# Altium schematic sheet ZYNQ_US_SOC_PL_GTX.SchDoc (part 3 of 3)
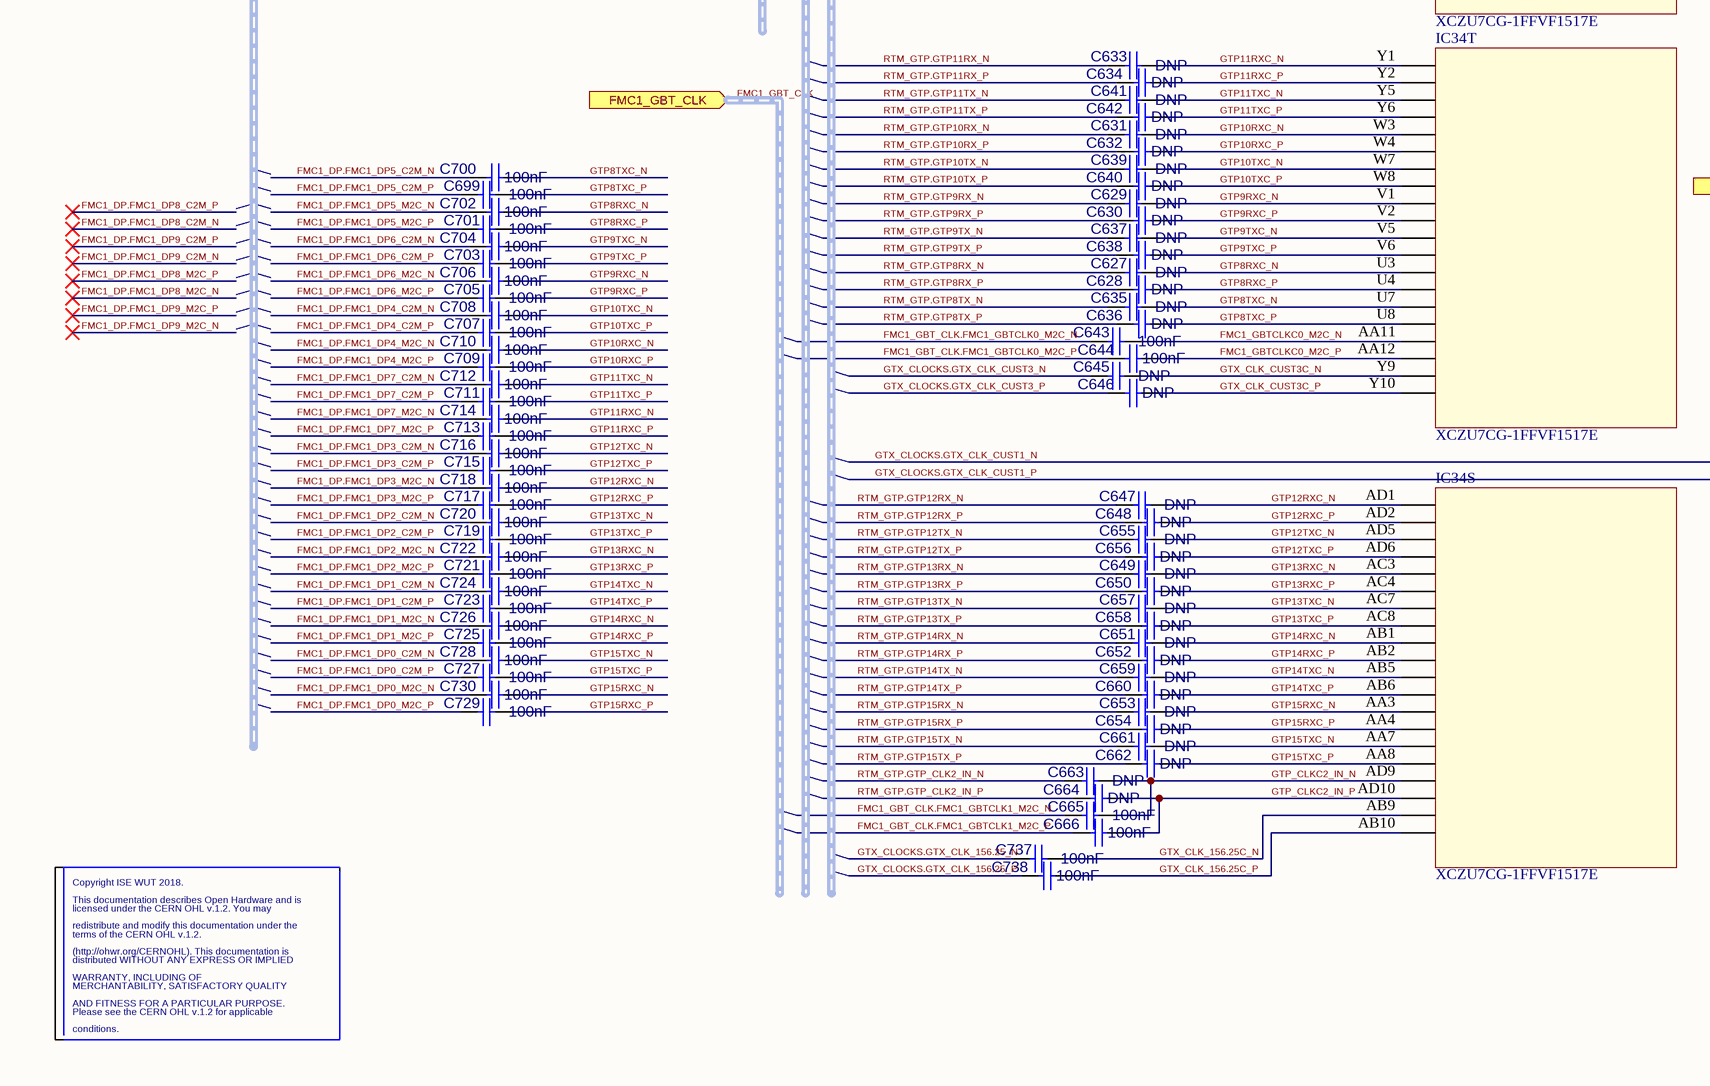
[diagram p4: ZYNQ_US_SOC_PL_GTX.SchDoc, bottom left]

## Library data of the parts (continued)
C735 = CAPC0603X33N: Capacitor - non polarized CAPC0603X33N 100nF; Manufacturer Part Number: CC0201_100NF_6.3V_10%_X5R; Manufacturer: GENERIC; Part Description: SMD Multilayer Chip Ceramic Capacitor; CmpIndex: 946; DXDB_LIBNAME: Capacitors SMD; Ref Designator: C735; SymIndex: 331; Tolerance: ±10%; Cell Name: CAPC0603X33N; Part Name: Capacitor - non polarized CAPC0603X33N; Part Number: Capacitor - non polarized CAPC0603X33N; Orientation: 0 = 0
C736 = CAPC0603X33N: Capacitor - non polarized CAPC0603X33N 100nF; Manufacturer Part Number: CC0201_100NF_6.3V_10%_X5R; Manufacturer: GENERIC; Part Description: SMD Multilayer Chip Ceramic Capacitor; CmpIndex: 945; DXDB_LIBNAME: Capacitors SMD; Ref Designator: C736; SymIndex: 331; Tolerance: ±10%; Cell Name: CAPC0603X33N; Part Name: Capacitor - non polarized CAPC0603X33N; Part Number: Capacitor - non polarized CAPC0603X33N; Orientation: 0 = 0
C737 = CAPC0603X33N: Capacitor - non polarized CAPC0603X33N 100nF; Manufacturer Part Number: CC0201_100NF_6.3V_10%_X5R; Manufacturer: GENERIC; Part Description: SMD Multilayer Chip Ceramic Capacitor; CmpIndex: 948; DXDB_LIBNAME: Capacitors SMD; Ref Designator: C737; SymIndex: 331; Tolerance: ±10%; Cell Name: CAPC0603X33N; Part Name: Capacitor - non polarized CAPC0603X33N; Part Number: Capacitor - non polarized CAPC0603X33N; Orientation: 0 = 0
C738 = CAPC0603X33N: Capacitor - non polarized CAPC0603X33N 100nF; Manufacturer Part Number: CC0201_100NF_6.3V_10%_X5R; Manufacturer: GENERIC; Part Description: SMD Multilayer Chip Ceramic Capacitor; CmpIndex: 947; DXDB_LIBNAME: Capacitors SMD; Ref Designator: C738; SymIndex: 331; Tolerance: ±10%; Cell Name: CAPC0603X33N; Part Name: Capacitor - non polarized CAPC0603X33N; Part Number: Capacitor - non polarized CAPC0603X33N; Orientation: 0 = 0
C739 = CAPC0603X33N: Capacitor - non polarized CAPC0603X33N 100nF; Manufacturer Part Number: CC0201_100NF_6.3V_10%_X5R; Manufacturer: GENERIC; Part Description: SMD Multilayer Chip Ceramic Capacitor; CmpIndex: 949; DXDB_LIBNAME: Capacitors SMD; Ref Designator: C739; SymIndex: 331; Tolerance: ±10%; Cell Name: CAPC0603X33N; Part Name: Capacitor - non polarized CAPC0603X33N; Part Number: Capacitor - non polarized CAPC0603X33N; Orientation: 0 = 0
C740 = CAPC0603X33N: Capacitor - non polarized CAPC0603X33N 100nF; Manufacturer Part Number: CC0201_100NF_6.3V_10%_X5R; Manufacturer: GENERIC; Part Description: SMD Multilayer Chip Ceramic Capacitor; CmpIndex: 950; DXDB_LIBNAME: Capacitors SMD; Ref Designator: C740; SymIndex: 331; Tolerance: ±10%; Cell Name: CAPC0603X33N; Part Name: Capacitor - non polarized CAPC0603X33N; Part Number: Capacitor - non polarized CAPC0603X33N; Orientation: 0 = 0
C741 = CAPC0603X33N: Capacitor - non polarized CAPC0603X33N 100nF; Manufacturer Part Number: CC0201_100NF_6.3V_10%_X5R; Manufacturer: GENERIC; Part Description: SMD Multilayer Chip Ceramic Capacitor; CmpIndex: 951; DXDB_LIBNAME: Capacitors SMD; Ref Designator: C741; SymIndex: 331; Tolerance: ±10%; Cell Name: CAPC0603X33N; Part Name: Capacitor - non polarized CAPC0603X33N; Part Number: Capacitor - non polarized CAPC0603X33N; Orientation: 0 = 0
C742 = CAPC0603X33N: Capacitor - non polarized CAPC0603X33N 100nF; Manufacturer Part Number: CC0201_100NF_6.3V_10%_X5R; Manufacturer: GENERIC; Part Description: SMD Multilayer Chip Ceramic Capacitor; CmpIndex: 952; DXDB_LIBNAME: Capacitors SMD; Ref Designator: C742; SymIndex: 331; Tolerance: ±10%; Cell Name: CAPC0603X33N; Part Name: Capacitor - non polarized CAPC0603X33N; Part Number: Capacitor - non polarized CAPC0603X33N; Orientation: 0 = 0
C925 = CAPC0603X33N: Capacitor - non polarized CAPC0603X33N 100nF; Manufacturer Part Number: CC0201_100NF_6.3V_10%_X5R; Manufacturer: GENERIC; Part Description: SMD Multilayer Chip Ceramic Capacitor; CmpIndex: 1180; DXDB_LIBNAME: Capacitors SMD; Ref Designator: C925; SymIndex: 331; Tolerance: ±10%; Cell Name: CAPC0603X33N; Part Name: Capacitor - non polarized CAPC0603X33N; Part Number: Capacitor - non polarized CAPC0603X33N; Orientation: 0 = 0
C926 = CAPC0603X33N: Capacitor - non polarized CAPC0603X33N 100nF; Manufacturer Part Number: CC0201_100NF_6.3V_10%_X5R; Manufacturer: GENERIC; Part Description: SMD Multilayer Chip Ceramic Capacitor; CmpIndex: 1178; DXDB_LIBNAME: Capacitors SMD; Ref Designator: C926; SymIndex: 331; Tolerance: ±10%; Cell Name: CAPC0603X33N; Part Name: Capacitor - non polarized CAPC0603X33N; Part Number: Capacitor - non polarized CAPC0603X33N; Orientation: 0 = 0
C927 = CAPC0603X33N: Capacitor - non polarized CAPC0603X33N 100nF; Manufacturer Part Number: CC0201_100NF_6.3V_10%_X5R; Manufacturer: GENERIC; Part Description: SMD Multilayer Chip Ceramic Capacitor; CmpIndex: 1179; DXDB_LIBNAME: Capacitors SMD; Ref Designator: C927; SymIndex: 331; Tolerance: ±10%; Cell Name: CAPC0603X33N; Part Name: Capacitor - non polarized CAPC0603X33N; Part Number: Capacitor - non polarized CAPC0603X33N; Orientation: 0 = 0
C928 = CAPC0603X33N: Capacitor - non polarized CAPC0603X33N 100nF; Manufacturer Part Number: CC0201_100NF_6.3V_10%_X5R; Manufacturer: GENERIC; Part Description: SMD Multilayer Chip Ceramic Capacitor; CmpIndex: 1181; DXDB_LIBNAME: Capacitors SMD; Ref Designator: C928; SymIndex: 331; Tolerance: ±10%; Cell Name: CAPC0603X33N; Part Name: Capacitor - non polarized CAPC0603X33N; Part Number: Capacitor - non polarized CAPC0603X33N; Orientation: 0 = 0
C929 = CAPC0603X33N: Capacitor - non polarized CAPC0603X33N 100nF; Manufacturer Part Number: CC0201_100NF_6.3V_10%_X5R; Manufacturer: GENERIC; Part Description: SMD Multilayer Chip Ceramic Capacitor; CmpIndex: 1183; DXDB_LIBNAME: Capacitors SMD; Ref Designator: C929; SymIndex: 331; Tolerance: ±10%; Cell Name: CAPC0603X33N; Part Name: Capacitor - non polarized CAPC0603X33N; Part Number: Capacitor - non polarized CAPC0603X33N; Orientation: 0 = 0
C930 = CAPC0603X33N: Capacitor - non polarized CAPC0603X33N 100nF; Manufacturer Part Number: CC0201_100NF_6.3V_10%_X5R; Manufacturer: GENERIC; Part Description: SMD Multilayer Chip Ceramic Capacitor; CmpIndex: 1182; DXDB_LIBNAME: Capacitors SMD; Ref Designator: C930; SymIndex: 331; Tolerance: ±10%; Cell Name: CAPC0603X33N; Part Name: Capacitor - non polarized CAPC0603X33N; Part Number: Capacitor - non polarized CAPC0603X33N; Orientation: 0 = 0
C931 = CAPC0603X33N: Capacitor - non polarized CAPC0603X33N 100nF; Manufacturer Part Number: CC0201_100NF_6.3V_10%_X5R; Manufacturer: GENERIC; Part Description: SMD Multilayer Chip Ceramic Capacitor; CmpIndex: 1184; DXDB_LIBNAME: Capacitors SMD; Ref Designator: C931; SymIndex: 331; Tolerance: ±10%; Cell Name: CAPC0603X33N; Part Name: Capacitor - non polarized CAPC0603X33N; Part Number: Capacitor - non polarized CAPC0603X33N; Orientation: 0 = 0
C932 = CAPC0603X33N: Capacitor - non polarized CAPC0603X33N 100nF; Manufacturer Part Number: CC0201_100NF_6.3V_10%_X5R; Manufacturer: GENERIC; Part Description: SMD Multilayer Chip Ceramic Capacitor; CmpIndex: 1185; DXDB_LIBNAME: Capacitors SMD; Ref Designator: C932; SymIndex: 331; Tolerance: ±10%; Cell Name: CAPC0603X33N; Part Name: Capacitor - non polarized CAPC0603X33N; Part Number: Capacitor - non polarized CAPC0603X33N; Orientation: 0 = 0
C933 = CAPC0603X33N: Capacitor - non polarized CAPC0603X33N 100nF; Manufacturer Part Number: CC0201_100NF_6.3V_10%_X5R; Manufacturer: GENERIC; Part Description: SMD Multilayer Chip Ceramic Capacitor; CmpIndex: 1200; DXDB_LIBNAME: Capacitors SMD; Ref Designator: C933; SymIndex: 331; Tolerance: ±10%; Cell Name: CAPC0603X33N; Part Name: Capacitor - non polarized CAPC0603X33N; Part Number: Capacitor - non polarized CAPC0603X33N; Orientation: 0 = 0
C934 = CAPC0603X33N: Capacitor - non polarized CAPC0603X33N 100nF; Manufacturer Part Number: CC0201_100NF_6.3V_10%_X5R; Manufacturer: GENERIC; Part Description: SMD Multilayer Chip Ceramic Capacitor; CmpIndex: 1199; DXDB_LIBNAME: Capacitors SMD; Ref Designator: C934; SymIndex: 331; Tolerance: ±10%; Cell Name: CAPC0603X33N; Part Name: Capacitor - non polarized CAPC0603X33N; Part Number: Capacitor - non polarized CAPC0603X33N; Orientation: 0 = 0
C935 = CAPC0603X33N: Capacitor - non polarized CAPC0603X33N 100nF; Manufacturer Part Number: CC0201_100NF_6.3V_10%_X5R; Manufacturer: GENERIC; Part Description: SMD Multilayer Chip Ceramic Capacitor; CmpIndex: 1193; DXDB_LIBNAME: Capacitors SMD; Ref Designator: C935; SymIndex: 331; Tolerance: ±10%; Cell Name: CAPC0603X33N; Part Name: Capacitor - non polarized CAPC0603X33N; Part Number: Capacitor - non polarized CAPC0603X33N; Orientation: 0 = 0
C936 = CAPC0603X33N: Capacitor - non polarized CAPC0603X33N 100nF; Manufacturer Part Number: CC0201_100NF_6.3V_10%_X5R; Manufacturer: GENERIC; Part Description: SMD Multilayer Chip Ceramic Capacitor; CmpIndex: 1195; DXDB_LIBNAME: Capacitors SMD; Ref Designator: C936; SymIndex: 331; Tolerance: ±10%; Cell Name: CAPC0603X33N; Part Name: Capacitor - non polarized CAPC0603X33N; Part Number: Capacitor - non polarized CAPC0603X33N; Orientation: 0 = 0
C937 = CAPC0603X33N: Capacitor - non polarized CAPC0603X33N 100nF; Manufacturer Part Number: CC0201_100NF_6.3V_10%_X5R; Manufacturer: GENERIC; Part Description: SMD Multilayer Chip Ceramic Capacitor; CmpIndex: 1187; DXDB_LIBNAME: Capacitors SMD; Ref Designator: C937; SymIndex: 331; Tolerance: ±10%; Cell Name: CAPC0603X33N; Part Name: Capacitor - non polarized CAPC0603X33N; Part Number: Capacitor - non polarized CAPC0603X33N; Orientation: 0 = 0
C938 = CAPC0603X33N: Capacitor - non polarized CAPC0603X33N 100nF; Manufacturer Part Number: CC0201_100NF_6.3V_10%_X5R; Manufacturer: GENERIC; Part Description: SMD Multilayer Chip Ceramic Capacitor; CmpIndex: 1194; DXDB_LIBNAME: Capacitors SMD; Ref Designator: C938; SymIndex: 331; Tolerance: ±10%; Cell Name: CAPC0603X33N; Part Name: Capacitor - non polarized CAPC0603X33N; Part Number: Capacitor - non polarized CAPC0603X33N; Orientation: 0 = 0
C939 = CAPC0603X33N: Capacitor - non polarized CAPC0603X33N 100nF; Manufacturer Part Number: CC0201_100NF_6.3V_10%_X5R; Manufacturer: GENERIC; Part Description: SMD Multilayer Chip Ceramic Capacitor; CmpIndex: 1190; DXDB_LIBNAME: Capacitors SMD; Ref Designator: C939; SymIndex: 331; Tolerance: ±10%; Cell Name: CAPC0603X33N; Part Name: Capacitor - non polarized CAPC0603X33N; Part Number: Capacitor - non polarized CAPC0603X33N; Orientation: 0 = 0
C940 = CAPC0603X33N: Capacitor - non polarized CAPC0603X33N 100nF; Manufacturer Part Number: CC0201_100NF_6.3V_10%_X5R; Manufacturer: GENERIC; Part Description: SMD Multilayer Chip Ceramic Capacitor; CmpIndex: 1192; DXDB_LIBNAME: Capacitors SMD; Ref Designator: C940; SymIndex: 331; Tolerance: ±10%; Cell Name: CAPC0603X33N; Part Name: Capacitor - non polarized CAPC0603X33N; Part Number: Capacitor - non polarized CAPC0603X33N; Orientation: 0 = 0
C941 = CAPC0603X33N: Capacitor - non polarized CAPC0603X33N 100nF; Manufacturer Part Number: CC0201_100NF_6.3V_10%_X5R; Manufacturer: GENERIC; Part Description: SMD Multilayer Chip Ceramic Capacitor; CmpIndex: 1188; DXDB_LIBNAME: Capacitors SMD; Ref Designator: C941; SymIndex: 331; Tolerance: ±10%; Cell Name: CAPC0603X33N; Part Name: Capacitor - non polarized CAPC0603X33N; Part Number: Capacitor - non polarized CAPC0603X33N; Orientation: 0 = 0
C942 = CAPC0603X33N: Capacitor - non polarized CAPC0603X33N 100nF; Manufacturer Part Number: CC0201_100NF_6.3V_10%_X5R; Manufacturer: GENERIC; Part Description: SMD Multilayer Chip Ceramic Capacitor; CmpIndex: 1186; DXDB_LIBNAME: Capacitors SMD; Ref Designator: C942; SymIndex: 331; Tolerance: ±10%; Cell Name: CAPC0603X33N; Part Name: Capacitor - non polarized CAPC0603X33N; Part Number: Capacitor - non polarized CAPC0603X33N; Orientation: 0 = 0
C943 = CAPC0603X33N: Capacitor - non polarized CAPC0603X33N 100nF; Manufacturer Part Number: CC0201_100NF_6.3V_10%_X5R; Manufacturer: GENERIC; Part Description: SMD Multilayer Chip Ceramic Capacitor; CmpIndex: 1196; DXDB_LIBNAME: Capacitors SMD; Ref Designator: C943; SymIndex: 331; Tolerance: ±10%; Cell Name: CAPC0603X33N; Part Name: Capacitor - non polarized CAPC0603X33N; Part Number: Capacitor - non polarized CAPC0603X33N; Orientation: 0 = 0
C944 = CAPC0603X33N: Capacitor - non polarized CAPC0603X33N 100nF; Manufacturer Part Number: CC0201_100NF_6.3V_10%_X5R; Manufacturer: GENERIC; Part Description: SMD Multilayer Chip Ceramic Capacitor; CmpIndex: 1197; DXDB_LIBNAME: Capacitors SMD; Ref Designator: C944; SymIndex: 331; Tolerance: ±10%; Cell Name: CAPC0603X33N; Part Name: Capacitor - non polarized CAPC0603X33N; Part Number: Capacitor - non polarized CAPC0603X33N; Orientation: 0 = 0
C945 = CAPC0603X33N: Capacitor - non polarized CAPC0603X33N 100nF; Manufacturer Part Number: CC0201_100NF_6.3V_10%_X5R; Manufacturer: GENERIC; Part Description: SMD Multilayer Chip Ceramic Capacitor; CmpIndex: 1189; DXDB_LIBNAME: Capacitors SMD; Ref Designator: C945; SymIndex: 331; Tolerance: ±10%; Cell Name: CAPC0603X33N; Part Name: Capacitor - non polarized CAPC0603X33N; Part Number: Capacitor - non polarized CAPC0603X33N; Orientation: 0 = 0
C946 = CAPC0603X33N: Capacitor - non polarized CAPC0603X33N 100nF; Manufacturer Part Number: CC0201_100NF_6.3V_10%_X5R; Manufacturer: GENERIC; Part Description: SMD Multilayer Chip Ceramic Capacitor; CmpIndex: 1198; DXDB_LIBNAME: Capacitors SMD; Ref Designator: C946; SymIndex: 331; Tolerance: ±10%; Cell Name: CAPC0603X33N; Part Name: Capacitor - non polarized CAPC0603X33N; Part Number: Capacitor - non polarized CAPC0603X33N; Orientation: 0 = 0
C947 = CAPC0603X33N: Capacitor - non polarized CAPC0603X33N 100nF; Manufacturer Part Number: CC0201_100NF_6.3V_10%_X5R; Manufacturer: GENERIC; Part Description: SMD Multilayer Chip Ceramic Capacitor; CmpIndex: 1191; DXDB_LIBNAME: Capacitors SMD; Ref Designator: C947; SymIndex: 331; Tolerance: ±10%; Cell Name: CAPC0603X33N; Part Name: Capacitor - non polarized CAPC0603X33N; Part Number: Capacitor - non polarized CAPC0603X33N; Orientation: 0 = 0
C948 = CAPC0603X33N: Capacitor - non polarized CAPC0603X33N 100nF; Manufacturer Part Number: CC0201_100NF_6.3V_10%_X5R; Manufacturer: GENERIC; Part Description: SMD Multilayer Chip Ceramic Capacitor; CmpIndex: 1201; DXDB_LIBNAME: Capacitors SMD; Ref Designator: C948; SymIndex: 331; Tolerance: ±10%; Cell Name: CAPC0603X33N; Part Name: Capacitor - non polarized CAPC0603X33N; Part Number: Capacitor - non polarized CAPC0603X33N; Orientation: 0 = 0
R347 = (no symbol name): Manufacturer Part Number: R0402_100R_1%_0.0625W_100PPM; Manufacturer: GENERIC; Part Description: General Purpose Thick Film Chip Resistor; CmpIndex: 954; DXDB_LIBNAME: Resistors SMD; Ref Designator: R347; SymIndex: 317; Cell Name: RESC1005X40N; Part Name: Resistor - 1% RESC1005X40N; Part Number: Resistor - 1% RESC1005X40N; Tolerance: ±1%; Orientation: 0 = 0